# EasyEDA Pro project 2-64 M circuit board.eprj

# Schematic FUJICA AX-5
Create Date: 2026-02-10; Page Name: 2-64 M circuit board; Project Name: 2-64 M circuit board; Schematic Name: FUJICA AX-5; Update Date: 2026-02-10; Company: EasyEDA.com; Page Size: A4; Version: V1.0
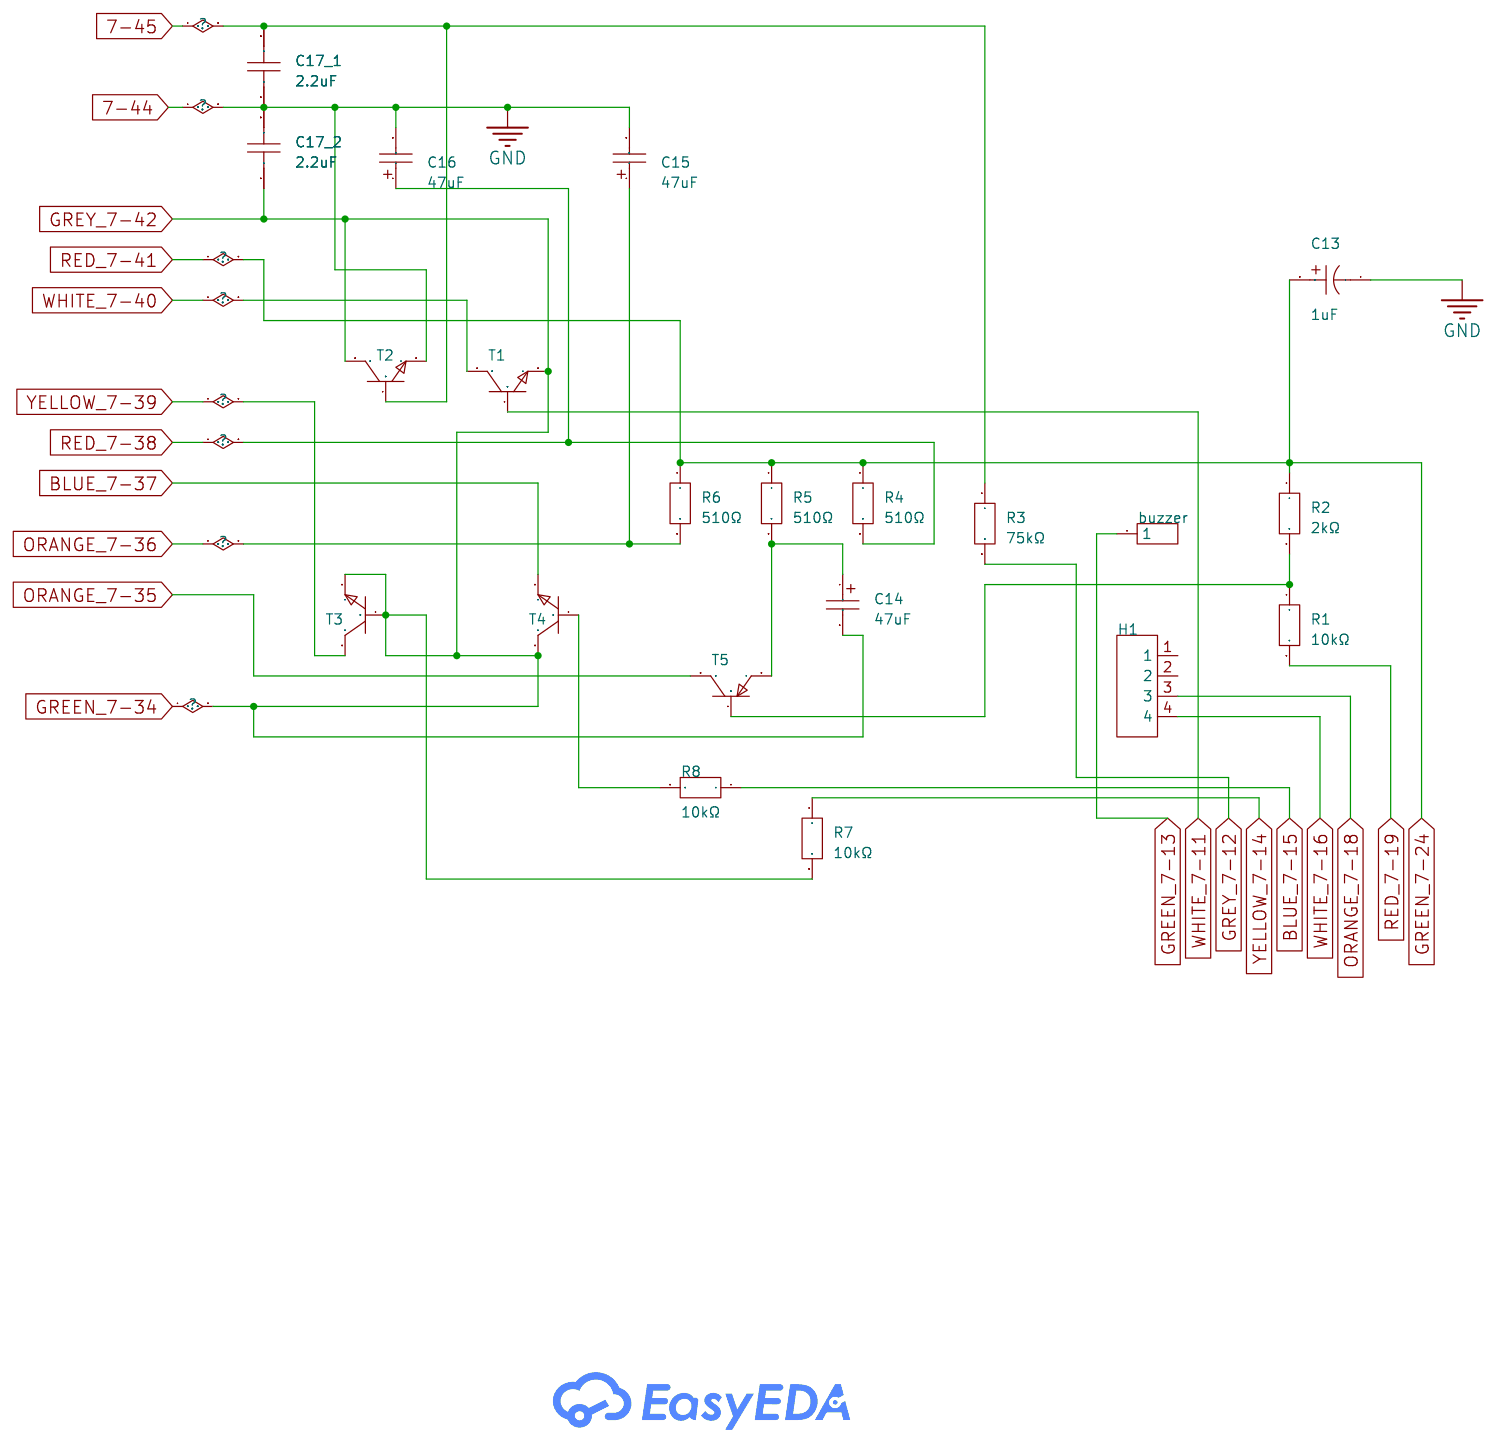
[diagram p0: schematic sheet]

## Parts
buzzer  -  [HDR-TH_1P-V-M_XKB_X4611WV-01I-C28D40]
C13  1uF  [CAP-TH_BD4.5-P2.50-D1.0-FD]
C14  47uF  [CAP-TH_BD5.0-P2.5-D0.5-FD]
C15  47uF  [CAP-TH_BD5.0-P2.5-D0.5-FD]
C16  47uF  [CAP-TH_BD5.0-P2.5-D0.5-FD]
C17_1  2.2uF  [CAP-TH_BD4.5-P2.50-D1.0-FD]
C17_2  2.2uF  [CAP-TH_BD4.5-P2.50-D1.0-FD]
H1  -  [HDR-TH_4P-P2.54-V-M]
R1  510Ω  [RES-TH_BD1.9-L3.3-P7.30-D0.5]
R2  510Ω  [RES-TH_BD1.9-L3.3-P7.30-D0.5]
R3  510Ω  [RES-TH_BD1.9-L3.3-P7.30-D0.5]
R4  510Ω  [RES-TH_BD1.9-L3.3-P7.30-D0.5]
R5  510Ω  [RES-TH_BD1.9-L3.3-P7.30-D0.5]
R6  510Ω  [RES-TH_BD1.9-L3.3-P7.30-D0.5]
R7  510Ω  [RES-TH_BD1.9-L3.3-P7.30-D0.5]
R8  510Ω  [RES-TH_BD1.9-L3.3-P7.30-D0.5]
T1  NPN-sot-23  [SOT-23-3_L2.9-W1.3-P0.95-LS2.4-BR]
T2  NPN-sot-23  [SOT-23-3_L2.9-W1.3-P0.95-LS2.4-BR]
T3  NPN-sot-23  [SOT-23-3_L2.9-W1.3-P0.95-LS2.4-BR]
T4  NPN-sot-23  [SOT-23-3_L2.9-W1.3-P0.95-LS2.4-BR]
T5  PNP-sot-23  [SOT-23-3_L2.9-W1.3-P1.90-LS2.4-BR]

## Library data of the parts
buzzer = HDR-M_2.54_1x1P: Supplier Footprint: Through
C13 = TAP105K035SCS: Capacitance:1uF Tolerance:±10% Tolerance:±10% Voltage Rating:35V Equivalent Series Resistance(ESR):8Ω@100kHz Operating Temperature:-55℃~+125℃ Operating Temperature:-55℃~+125℃; LCSC Part Name: 1uF ±10% 35V; Supplier Part: C2987014; Manufacturer: Kyocera AVX; Supplier Footprint: 插件,P=2.5mm; JLCPCB Part Class: Extended Part; Supplier: LCSC; Tolerance: ±10%; Voltage Rating: 35V; Equivalent Series Resistance(ESR): 8Ω@100kHz; Operating Temperature: -55℃~+125℃
C14-C16 = TAP476K016SCS: Capacitance: Tolerance:±10% Tolerance:±10% Rated Voltage: Equivalent Series Resistance(ESR):1.3Ω@100kHz Operating Temperature:-55℃~+125℃ Operating Temperature:-55℃~+125℃; LCSC Part Name: 47uF ±10% 16V; Supplier Part: C56699; Manufacturer: Kyocera AVX; Supplier Footprint: 插件,P=2.5mm; JLCPCB Part Class: Extended Part; Datasheet: https://atta.szlcsc.com/upload/public/pdf/source/20191107/C444779_CCD9EA7F36AC07ADEC9ACFBB03523055.pdf; Supplier: LCSC; Tolerance: ±10%; Equivalent Series Resistance(ESR): 1.3Ω@100kHz; Operating Temperature: -55℃~+125℃
C17_1 C17_2 = TAP225K035SCS: Capacitance: Tolerance:±10% Tolerance:±10% Rated Voltage: Equivalent Series Resistance(ESR):5Ω@100kHz Operating Temperature:-55℃~+125℃ Operating Temperature:-55℃~+125℃; LCSC Part Name: 2.2uF ±10% 35V; Supplier Part: C50520; Manufacturer: Kyocera AVX; Supplier Footprint: 插件,P=5mm; JLCPCB Part Class: Extended Part; Datasheet: https://atta.szlcsc.com/upload/public/pdf/source/20191107/C444779_CCD9EA7F36AC07ADEC9ACFBB03523055.pdf; Supplier: LCSC; Tolerance: ±10%; Equivalent Series Resistance(ESR): 5Ω@100kHz; Operating Temperature: -55℃~+125℃
H1 = HDR-M_2.54_1x4P: Supplier Footprint: Through
R1-R8 = MF0S4FF5100A50: Type:Metal Film Resistors Resistance:510Ω Tolerance:±1% Tolerance:±1% Power(Watts):250mW; LCSC Part Name: 金属膜电阻 510Ω ±1% 250mW 温漂：±50PPM; Supplier Part: C18724267; Manufacturer: UNI-ROYAL(厚声); Supplier Footprint: 插件,D1.9xL3.3mm; JLCPCB Part Class: Extended Part; Datasheet: https://atta.szlcsc.com/upload/public/pdf/source/20200826/C778422_A75C16D24F3F4B91F841C5277BB30A6A.pdf; Supplier: LCSC; Type: Metal Film Resistors; Tolerance: ±1%; Power(Watts): 250mW
T1-T4 = NPN-sot-23: Supplier Part: C9900005297; Supplier Footprint: SOT-23; JLCPCB Part Class: Extended Part; Supplier: LCSC
T5 = PNP-sot-23: Supplier Part: C9900005269; Supplier Footprint: SOT-23-3; JLCPCB Part Class: Extended Part; Supplier: LCSC

## Nets
GND: C13.1 C15.2 C16.2 C17_1.1 C17_2.2 T2.2(E)
7-45: C17_1.2 R3.1 T2.1(B)
BLUE_7-15: R8.1
BLUE_7-37: T4.2(E)
GREEN_7-13: buzzer.1
GREEN_7-24: C13.2 R2.1 R4.1 R5.1 R6.1
GREEN_7-34: C14.2 C17_2.1 R7.2 T1.2(E) T2.3(C) T3.1(B) T3.2(E) T4.3(C)
GREY_7-12: R3.2
ORANGE_7-18: H1.3
ORANGE_7-35: T5.3(C)
ORANGE_7-36: C15.1 R6.2
RED_7-19: R1.2
RED_7-38: C16.1 R4.2
WHITE_7-11: T1.1(B)
WHITE_7-16: H1.4
WHITE_7-40: T1.3(C)
YELLOW_7-14: R7.1
YELLOW_7-39: T3.3(C)
$C14_1: C14.1 R5.2 T5.2(E)
$R1_1: R1.1 R2.2 T5.1(B)
$R8_2: R8.2 T4.1(B)

Not connected (* = marked no-connect by the designer): H1 1 2

# Board PCB1
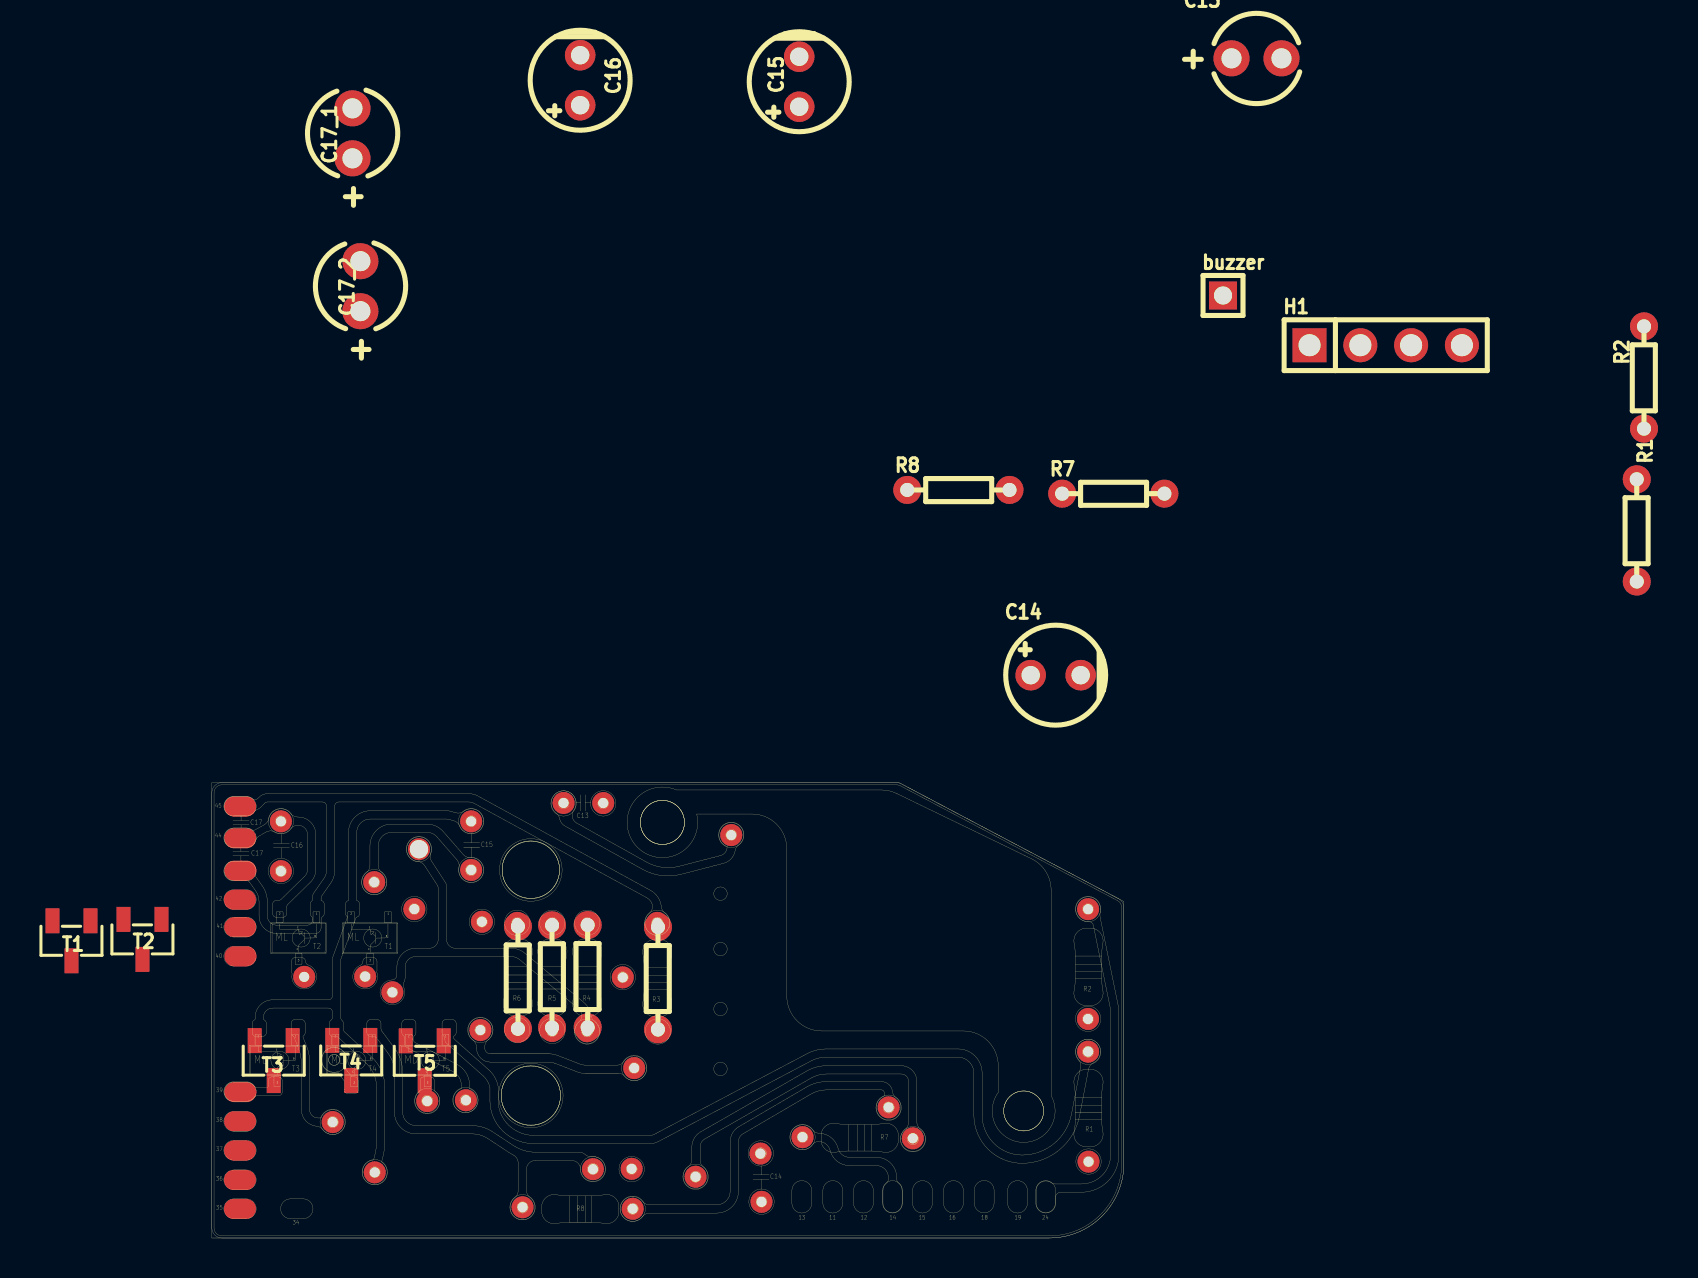
[diagram p1: board, top side]
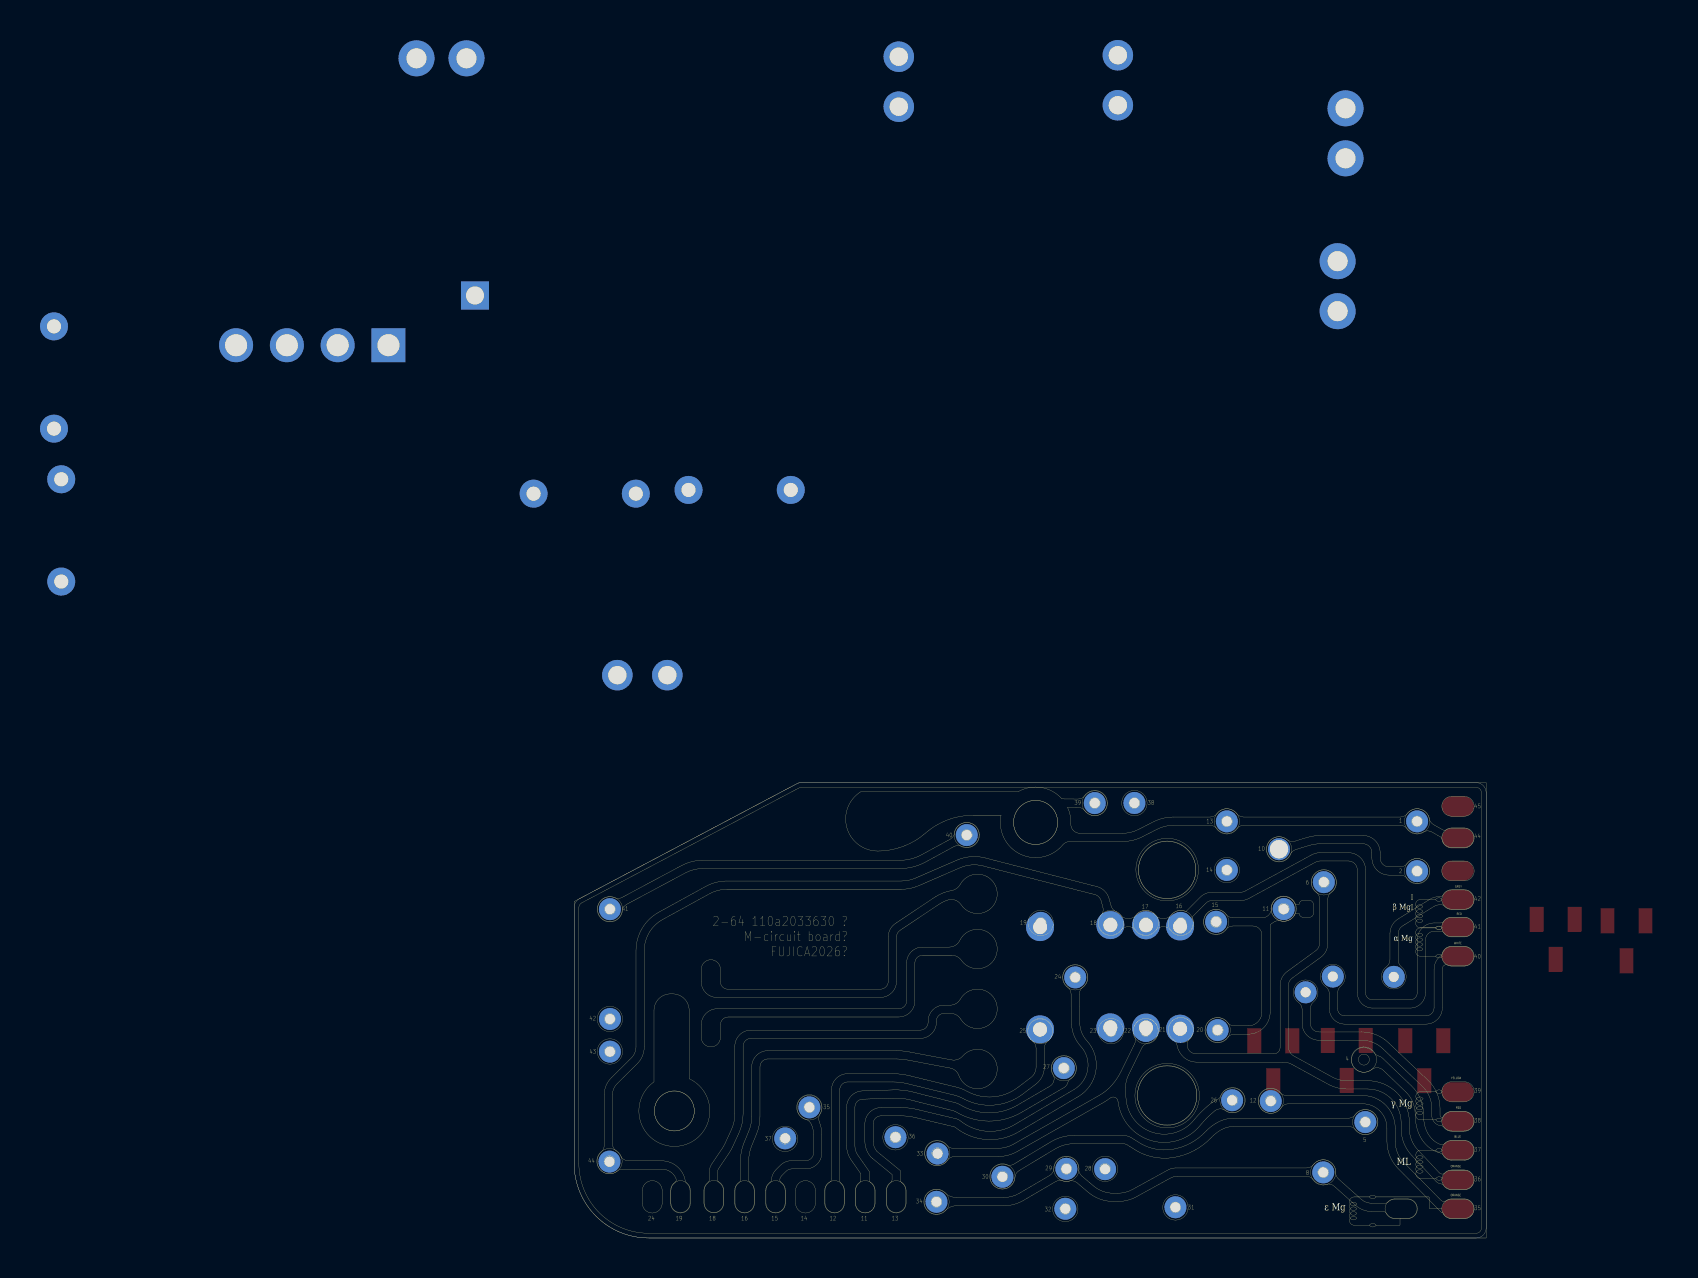
[diagram p2: board, bottom side, seen from below]

Outline 45.61 x 22.77 mm; copper layers: Top Layer, Bottom Layer. Coordinates in mm from the lower left corner of the outline.
Outline path: 0,22.27 0,0.5 arc(0.15,0.15) 0.5,0 41.88,0 arc(44.52,1.09) 45.61,3.73 45.61,16.52 arc(45.54,16.78) 45.35,16.97 34.48,22.71 arc(34.37,22.75) 34.25,22.77 0.5,22.77 arc(0.15,22.62) 0,22.27
Stack: Top Layer 0.035mm / Dielectric1 1.51mm FR4 er 4.5 / Bottom Layer 0.035mm

## Design rules (mm)
template: JLCPCB Capability(Two Layers Board)
spacing copperThickness1oz (default): track to track 0.102, other pairs 0.152 to 0.3
spacing copperThickness2oz: track to track 0.203, other pairs 0.152 to 0.3
track width copperThickness1oz (default): min 0.127, default 0.254, max 2.54
track width copperThickness2oz: min 0.203, default 0.254, max 2.54
differential pair differentialPair (default): width min 0.127, default 0.254, max 2.54; gap min 0.152, default 0.152
via viaSize (default): diameter min 0.5, default 0.61, max 10; hole min 0.3, default 0.305, max 6.3

## Placement (name value [footprint] x y rotation side)
buzzer  -  [HDR-TH_1P-V-M_XKB_X4611WV-01I-C28D40]  50.57 47.13 0 top
C13  1uF  [CAP-TH_BD4.5-P2.50-D1.0-FD]  52.25 58.99 0 top
C14  47uF  [CAP-TH_BD5.0-P2.5-D0.5-FD]  42.2 28.14 0 top
C15  47uF  [CAP-TH_BD5.0-P2.5-D0.5-FD]  29.38 57.82 90 top
C16  47uF  [CAP-TH_BD5.0-P2.5-D0.5-FD]  18.42 57.89 90 top
C17_1  2.2uF  [CAP-TH_BD4.5-P2.50-D1.0-FD]  7.03 55.24 90 top
C17_2  2.2uF  [CAP-TH_BD4.5-P2.50-D1.0-FD]  7.43 47.59 90 top
H1  -  [HDR-TH_4P-P2.54-V-M]  58.71 44.64 0 top
NOREF  -  [Pad_e1493]  10.13 16.45 0 top
NOREF#2  -  [Pad_e1498]  33.85 6.53 0 top
NOREF#3  -  [Pad_e1488]  22.28 15.76 0 top
NOREF#4  -  [Pad_e1487]  22.3 10.33 0 top
NOREF#5  -  [Pad_e1472]  13.43 10.4 0 top
NOREF#6  -  [Pad_e1473]  6.04 5.8 0 top
NOREF#7  -  [Pad_e1504]  12.71 6.89 0 top
NOREF#8  -  [Pad_e1474]  8.15 3.28 0 top
NOREF#9  -  [Pad_e1492]  13.51 15.81 0 top
NOREF#10  -  [Pad_e1497]  29.54 5.04 0 top
NOREF#11  -  [Pad_e1521]  1.42 15.54 0 top
NOREF#12  -  [Pad_e1477]  21 3.46 0 top
NOREF#13  -  [Pad_e1524]  1.42 19.99 0 top
NOREF#14  -  [Pad_e1486]  3.45 18.34 0 top
NOREF#15  -  [Pad_e1480]  27.49 1.81 0 top
NOREF#16  -  [Pad_e1519]  1.43 7.3 0 top
NOREF#17  -  [Pad_e1518]  1.41 5.84 0 top
NOREF#18  -  [Pad_e1522]  1.4 16.91 0 top
NOREF#19  -  [Pad_e1523]  1.43 18.37 0 top
NOREF#20  -  [Pad_e1503]  43.82 16.44 0 top
NOREF#21  -  [Pad_e1500]  43.85 3.82 0 top
NOREF#22  -  [Pad_e1517]  1.41 4.38 0 top
NOREF#23  -  [Pad_e1520]  1.43 14.09 0 top
NOREF#24  -  [Pad_e1501]  43.82 9.32 0 top
NOREF#25  -  [Pad_e1506]  20.55 13.03 0 top
NOREF#26  -  [Pad_e1467]  10.36 19.44 0 top
NOREF#27  -  [Pad_e1499]  35.06 4.98 0 top
NOREF#28  -  [Pad_e1469]  12.97 18.4 0 top
NOREF#29  -  [Pad_e1491]  15.27 15.76 0 top
NOREF#30  -  [Pad_e1507]  21.05 1.46 0 top
NOREF#31  -  [Pad_e1525]  1.41 21.58 0 top
NOREF#32  -  [Pad_e1516]  1.4 2.9 0 top
NOREF#33  -  [Pad_e1484]  7.67 13.07 0 top
NOREF#34  -  [Pad_e1478]  24.19 3.06 0 top
NOREF#35  -  [Pad_e1471]  9.03 12.29 0 top
NOREF#36  -  [Pad_e1509]  15.27 10.41 0 top
NOREF#37  -  [Pad_e1485]  3.45 20.83 0 top
NOREF#38  -  [Pad_e1483]  4.62 13.06 0 top
NOREF#39  -  [Pad_e1479]  27.44 4.22 0 top
NOREF#40  -  [Pad_e1496]  19.57 21.75 0 top
NOREF#41  -  [Pad_e1494]  12.97 20.83 0 top
NOREF#42  -  [Pad_e1510]  17.02 10.35 0 top
NOREF#43  -  [Pad_e1489]  18.77 15.76 0 top
NOREF#44  -  [Pad_e1502]  43.82 10.95 0 top
NOREF#45  -  [Pad_e1513]  1.4 1.45 0 top
NOREF#46  -  [Pad_e1482]  25.98 20.15 0 top
NOREF#47  -  [Pad_e1490]  17.02 15.76 0 top
NOREF#48  -  [Pad_e1505]  10.77 6.85 0 top
NOREF#49  -  [Pad_e1481]  21.12 8.5 0 top
NOREF#50  -  [Pad_e1470]  8.12 17.79 0 top
NOREF#51  -  [Pad_e1495]  17.59 21.75 0 top
NOREF#52  -  [Pad_e1475]  15.54 1.54 0 top
NOREF#53  -  [Pad_e1511]  18.76 10.34 0 top
NOREF#54  -  [Pad_e1476]  19.06 3.44 0 top
R1  510Ω  [RES-TH_BD1.9-L3.3-P7.30-D0.5]  71.27 35.37 270 top
R2  510Ω  [RES-TH_BD1.9-L3.3-P7.30-D0.5]  71.63 43.01 270 top
R3  510Ω  [RES-TH_BD1.9-L3.3-P7.30-D0.5]  22.31 12.97 270 top
R4  510Ω  [RES-TH_BD1.9-L3.3-P7.30-D0.5]  18.8 13.07 270 top
R5  510Ω  [RES-TH_BD1.9-L3.3-P7.30-D0.5]  17.01 13.06 270 top
R6  510Ω  [RES-TH_BD1.9-L3.3-P7.30-D0.5]  15.31 13.01 270 top
R7  510Ω  [RES-TH_BD1.9-L3.3-P7.30-D0.5]  45.1 37.22 0 top
R8  510Ω  [RES-TH_BD1.9-L3.3-P7.30-D0.5]  37.35 37.41 0 top
T1  NPN-sot-23  [SOT-23-3_L2.9-W1.3-P0.95-LS2.4-BR]  -7.02 14.86 90 top
T2  NPN-sot-23  [SOT-23-3_L2.9-W1.3-P0.95-LS2.4-BR]  -3.47 14.93 90 top
T3  NPN-sot-23  [SOT-23-3_L2.9-W1.3-P0.95-LS2.4-BR]  3.09 8.87 90 top
T4  NPN-sot-23  [SOT-23-3_L2.9-W1.3-P0.95-LS2.4-BR]  6.97 8.88 90 top
T5  PNP-sot-23  [SOT-23-3_L2.9-W1.3-P1.90-LS2.4-BR]  10.65 8.86 90 top

## Footprints (pads in the part's own frame, mm; a bottom-side part is the same pattern mirrored in y, then rotated)
CAP-TH_BD4.5-P2.50-D1.0-FD
  round 1.8 hole 1: 1(-1.25,0) 2(1.25,0)
CAP-TH_BD5.0-P2.5-D0.5-FD
  round 1.524 hole 0.914: 1(-1.25,0) 2(1.25,0)
HDR-TH_1P-V-M_XKB_X4611WV-01I-C28D40
  rect 1.4x1.4 hole 0.9: 1(0,0)
HDR-TH_4P-P2.54-V-M
  rect 1.7x1.7 hole 1.1: 1(-3.81,0)
  round 1.7 hole 1.1: 2(-1.27,0) 3(1.27,0) 4(3.81,0)
Pad_e1467
  round 1.1 hole 0.914x0.5: 10(0,0)
Pad_e1469
  round 1.1 hole 0.5: 14(0,0)
Pad_e1470
  round 1.1 hole 0.5: 6(0,0)
Pad_e1471
  round 1.1 hole 0.5: 14(0,0)
Pad_e1472
  round 1.1 hole 0.5: 20(0,0)
Pad_e1473
  round 1.1 hole 0.5: 5(0,0)
Pad_e1474
  round 1.1 hole 0.5: 8(0,0)
Pad_e1475
  round 1.1 hole 0.5: 14(0,0)
Pad_e1476
  round 1.1 hole 0.5: 14(0,0)
Pad_e1477
  round 1.1 hole 0.5: 14(0,0)
Pad_e1478
  round 1.1 hole 0.5: 14(0,0)
Pad_e1479
  round 1.1 hole 0.5: 14(0,0)
Pad_e1480
  round 1.1 hole 0.5: 14(0,0)
Pad_e1481
  round 1.1 hole 0.5: 14(0,0)
Pad_e1482
  round 1.1 hole 0.5: 14(0,0)
Pad_e1483
  round 1.1 hole 0.5: 14(0,0)
Pad_e1484
  round 1.1 hole 0.5: 14(0,0)
Pad_e1485
  round 1.1 hole 0.5: 1(0,0)
Pad_e1486
  round 1.1 hole 0.5: 2(0,0)
Pad_e1487
  round 1.1 hole 0.5: 14(0,0)
Pad_e1488
  round 1.1 hole 0.5: 19(0,0)
Pad_e1489
  round 1.1 hole 0.5: 18(0,0)
Pad_e1490
  round 1.1 hole 0.5: 17(0,0)
Pad_e1491
  round 1.1 hole 0.5: 14(0,0)
Pad_e1492
  round 1.1 hole 0.5: 15(0,0)
Pad_e1493
  round 1.1 hole 0.5: 11(0,0)
Pad_e1494
  round 1.1 hole 0.5: 14(0,0)
Pad_e1495
  round 1.1 hole 0.5: 14(0,0)
Pad_e1496
  round 1.1 hole 0.5: 14(0,0)
Pad_e1497
  round 1.1 hole 0.5: 14(0,0)
Pad_e1498
  round 1.1 hole 0.5: 14(0,0)
Pad_e1499
  round 1.1 hole 0.5: 14(0,0)
Pad_e1500
  round 1.1 hole 0.5: 14(0,0)
Pad_e1501
  round 1.1 hole 0.5: 14(0,0)
Pad_e1502
  round 1.1 hole 0.5: 14(0,0)
Pad_e1503
  round 1.1 hole 0.5: 14(0,0)
Pad_e1504
  round 1.1 hole 0.5: 26(0,0)
Pad_e1505
  round 1.1 hole 0.5: 12(0,0)
Pad_e1506
  round 1.1 hole 0.5: 24(0,0)
Pad_e1507
  round 1.1 hole 0.5: 14(0,0)
Pad_e1509
  round 1.1 hole 0.5: 21(0,0)
Pad_e1510
  round 1.1 hole 0.5: 22(0,0)
Pad_e1511
  round 1.1 hole 0.5: 23(0,0)
Pad_e1513
  oval 1.6x1 smd: 35(0,0)
Pad_e1516
  oval 1.6x1 smd: 35(0,0)
Pad_e1517
  oval 1.6x1 smd: 35(0,0)
Pad_e1518
  oval 1.6x1 smd: 35(0,0)
Pad_e1519
  oval 1.6x1 smd: 35(0,0)
Pad_e1520
  oval 1.6x1 smd: 35(0,0)
Pad_e1521
  oval 1.6x1 smd: 35(0,0)
Pad_e1522
  oval 1.6x1 smd: 35(0,0)
Pad_e1523
  oval 1.6x1 smd: 35(0,0)
Pad_e1524
  oval 1.6x1 smd: 35(0,0)
Pad_e1525
  oval 1.6x1 smd: 35(0,0)
RES-TH_BD1.9-L3.3-P7.30-D0.5
  round 1.4 hole 0.7: 1(-2.572,0) 2(2.541,0)
SOT-23-3_L2.9-W1.3-P0.95-LS2.4-BR
  rect 1.25x0.7 smd: 1(1,-0.95) 2(1,0.95) 3(-1,0)
SOT-23-3_L2.9-W1.3-P1.90-LS2.4-BR
  rect 1.25x0.7 smd: 1(1,-0.95) 2(1,0.95) 3(-1,0)

## Nets
As in the schematic.

Pads without a net: H1 1 2; NOREF 11; NOREF#2 14; NOREF#3 19; NOREF#4 14; NOREF#5 20; NOREF#6 5; NOREF#7 26; NOREF#8 8; NOREF#9 15; NOREF#10 14; NOREF#11 35; NOREF#12 14; NOREF#13 35; NOREF#14 2; NOREF#15 14; NOREF#16 35; NOREF#17 35; NOREF#18 35; NOREF#19 35; NOREF#20 14; NOREF#21 14; NOREF#22 35; NOREF#23 35; NOREF#24 14; NOREF#25 24; NOREF#26 10; NOREF#27 14; NOREF#28 14; NOREF#29 14; NOREF#30 14; NOREF#31 35; NOREF#32 35; NOREF#33 14; NOREF#34 14; NOREF#35 14; NOREF#36 21; NOREF#37 1; NOREF#38 14; NOREF#39 14; NOREF#40 14; NOREF#41 14; NOREF#42 22; NOREF#43 18; NOREF#44 14; NOREF#45 35; NOREF#46 14; NOREF#47 17; NOREF#48 12; NOREF#49 14; NOREF#50 6; NOREF#51 14; NOREF#52 14; NOREF#53 23; NOREF#54 14

## Text on the board
Bottom Silkscreen Layer: GREY | RED | WHITE | YELLOW | BLUE | ORANGE | 45 | 44 | 42 | 41 | 40 | 39 | 38 | 37 | 36 | 35 | 2 | 1 | 5 | 4 | 8 | 6 | 11 | 10 | 12 | 15 | 26 | 13 | 14 | 20 | 31 | 16 | 21 | 17 | 22 | 18 | 23 | 28 | 24 | 29 | 32 | 27 | 19 | 25 | 30 | 33 | 34 | 43 | 2-64 110a2033630 / M-circuit board / FUJICA2026 | β Mg | α Mg | ML | γ Mg | ε Mg
Top Silkscreen Layer: C | E | B | 2 | 3 | 1 | 45 | 44 | 42 | 40 | 39 | 38 | 37 | 36 | 35 | 41 | 34 | 13 | 11 | 12 | 14 | 15 | 16 | 18 | 19 | 24 | C17 | C14 | C16 | C15 | C13 | R6 | R5 | R8 | R4 | R3 | R7 | R2 | R1 | T3 | T2 | T4 | T1 | T5 | ML | MD
DXF ROUTE BOTTOM: 1 | 2 | 3 | 4 | 7 | 8 | 6 | 9 | 11 | 10 | 12 | 13 | 14 | 20 | 15 | 21 | 16 | 17 | 38 | 23 | 18 | 39 | 24 | 29 | 32 | 27 | 25 | 19 | 40 | 34 | 36 | 35 | 44 | 41 | 5 | 26 | 31 | 22 | 28 | 30 | 33 | 37 | 43 | 45 | 42
